# EasyEDA Pro project Access Control Core.eprj, board Card Reader (continued)
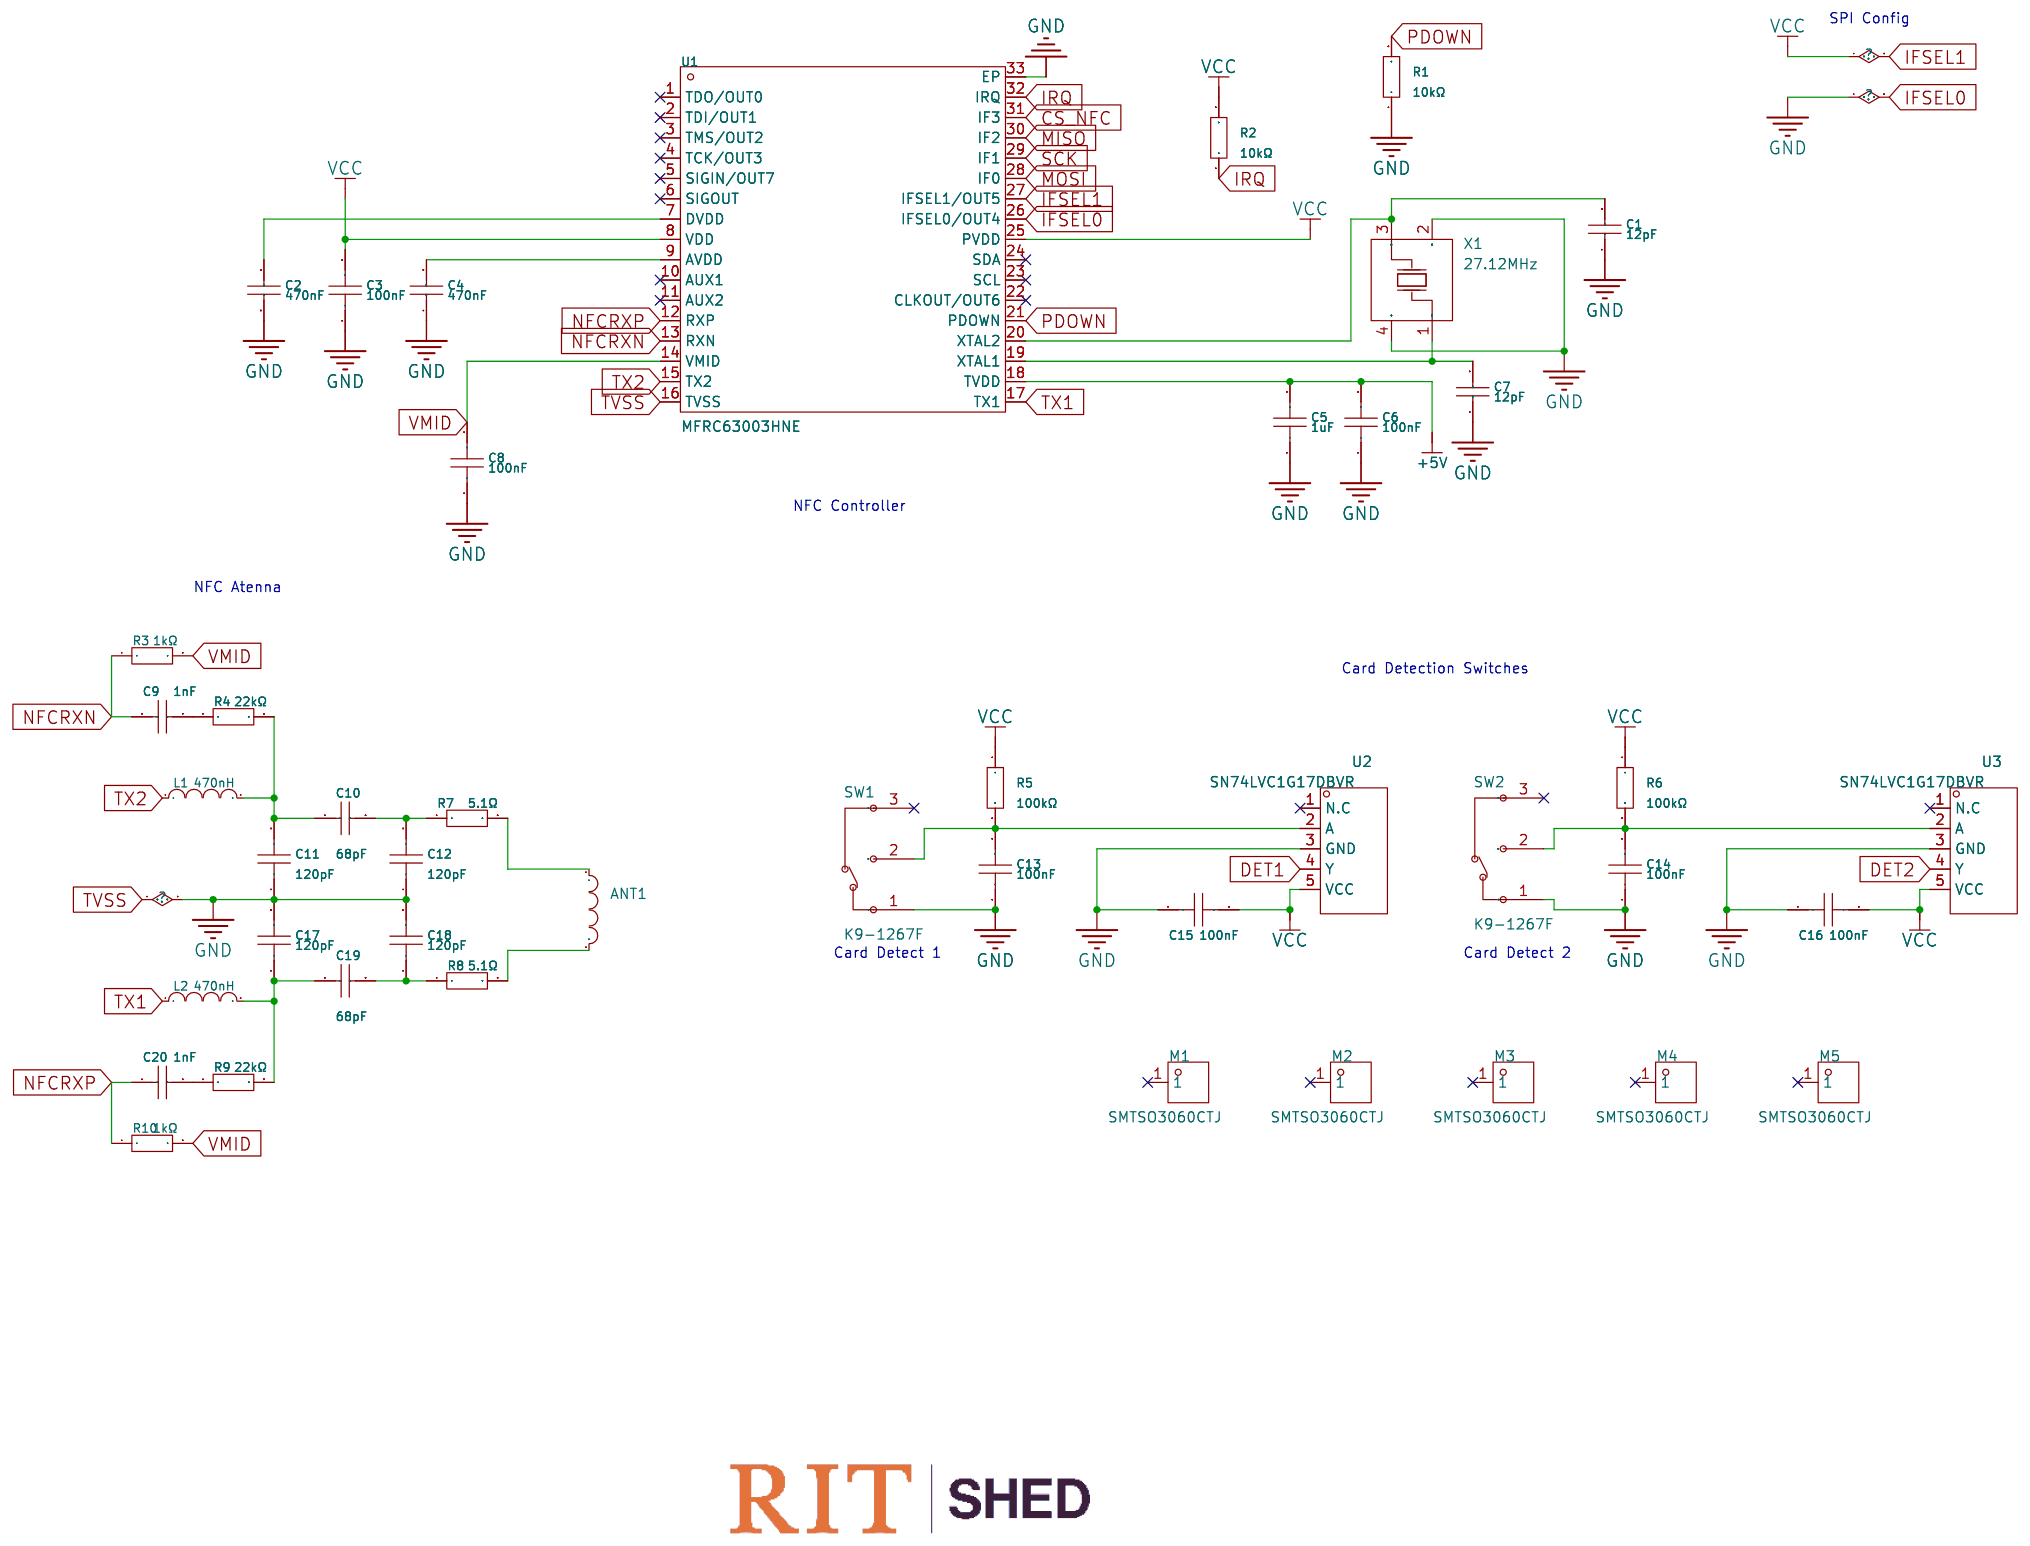
[diagram p0: NFC Reader]
## Footprints (pads in the part's own frame, mm; a bottom-side part is the same pattern mirrored in y, then rotated) (continued)
NFC Antenna Footprint
  round 1.524 hole 0.914: 1(-3.505,-18.542) 1(-3.505,-25.73) 2(3.15,-18.603)
R0603
  rect 0.806x0.864 smd: 1(-0.753,0) 2(0.753,0)
R0805
  rect 1.133x1.377 smd: 1(-1,0) 2(1,0)
RJ45-TH_HC911102A-904-A
  rect 1.6x1.6 hole 1: 1(-4.445,4.355)
  round 1.6 hole 1: 2(-3.175,6.895) 3(-1.905,4.355) 4(-0.635,6.895) 5(0.635,4.355) 6(1.905,6.895) 7(3.175,4.355) 8(4.445,6.895)
  round 1.8 hole 1.1: 9(-6.63,-6.895) 10(-4.09,-6.895) 11(4.09,-6.895) 12(6.63,-6.895)
  round 2.5 hole 1.8: 13(-7.875,1.055) 13(7.875,1.055)
SMD_SMTSO3060CTJ
  custom 2.95x2.95 smd: 1(-2.143,1.579) 1(-1.579,-2.143) 1(1.579,2.143) 1(2.143,-1.579)
SOD-123_L2.7-W1.6-LS3.7-RD-1
  rect 1.2x0.95 smd: 1(-1.7,0) 2(1.7,0)
SOD-123_L2.8-W1.8-LS3.7-RD
  rect 0.95x1.15 smd: 1(-1.692,0) 2(1.692,0)
SOD-123F_L2.8-W1.8-LS3.7-RD
  rect 1x1.2 smd: 1(-1.65,0) 2(1.65,0)
SOT-23-3_L3.0-W1.7-P0.95-LS2.9-BR
  rect 1.038x0.532 smd: 1(1.101,-0.95) 2(1.101,0.95) 3(-1.101,0)
SOT-23-5_L3.0-W1.7-P0.95-LS2.8-BR
  rect 1.1x0.6 smd: 1(1.3,-0.95) 2(1.3,0) 3(1.3,0.95) 4(-1.3,0.95) 5(-1.3,-0.95)
SOT-23-6_L2.9-W1.6-P0.95-LS2.8-BL
  rect 0.532x1.072 smd: 1(-0.95,-1.149) 2(0,-1.149) 3(0.95,-1.149) 4(0.95,1.149) 5(0,1.149) 6(-0.95,1.149)
SOT-23-6_L2.9-W1.6-P0.95-LS2.8-BR
  rect 1.1x0.6 smd: 1(1.35,-0.95) 2(1.35,0) 3(1.35,0.95) 4(-1.35,0.95) 5(-1.35,0) 6(-1.35,-0.95)
SOT-23-6_L2.9-W1.6-P0.95-LS2.9-BL
  rect 0.532x1.072 smd: 1(-0.95,-1.149) 2(0,-1.149) 3(0.95,-1.149) 4(0.95,1.149) 5(0,1.149) 6(-0.95,1.149)
SOT-563_L1.6-W1.2-P0.50-LS1.6-BR
  rect 0.6x0.3 smd: 1(0.75,-0.5) 2(0.75,0) 3(0.75,0.5) 4(-0.75,0.5) 5(-0.75,0) 6(-0.75,-0.5)
SOT-583-8_L2.1-W1.2-P0.50-LS1.6-BR
  rect 0.68x0.28 smd: 1(0.64,-0.75) 2(0.64,-0.25) 3(0.64,0.25) 4(0.64,0.75) 5(-0.64,0.75) 6(-0.64,0.25) 7(-0.64,-0.25) 8(-0.64,-0.75)
SW-SMD_L7.5-W8.0-P4.50_TS-1045-A13B3-D2
  rect 1x3 smd: 1(-2.25,1.15) 2(2.25,1.15)
  rect 1.8x1.3 smd: 3(-4.1,2.3) 3(4.1,2.3)
  oval 2x1.3 hole 1.2x0.6: 3(0,-2.3)
SW-TH_K9-1267F
  round 2.8 hole 1.5: 1(-5.08,0) 2(0,0) 3(5.08,0)
USB-C-SMD_HC-GAP-ACF012-1T-1
  oval 0.9x1.9 hole 0.6x1.6: 0(-1.43,2.375) 0(-1.43,-2.425) 0(1.43,2.375) 0(1.43,-2.425)
  round 0.6 hole 0.4: A1(-0.39,-2.475) A4(-0.39,-1.575) A5(-0.39,-0.675) A6(-0.39,0.225) A7(-0.39,1.125) A9(-0.39,2.025) A12(-0.39,2.925) B1(0.39,2.475) B4(0.39,1.575) B5(0.39,0.675) B6(0.39,-0.225) B7(0.39,-1.125) B9(0.39,-2.025) B12(0.39,-2.925)

## Nets
As in the schematic.

Pads without a net: BZR1 3 4; J1 0 A1 A12 B1 B12; J3 7; LED1 1; LED2 1; M1 1; M2 1; M3 1; M4 1; M5 1; SW1 3; SW2 3; U1 1 2 3 4 5 6 10 11 22 23 24; U2 1; U3 1; U4 1; U5 3; U6 11 12; U13 1 2; U15 1 2; U17 7 12 13 18 24 26 38 39 40 41 42 43 44 45 46 47; U21 4 5; U22 4 5

## Via types
v1: diameter 0.61, hole 0.305, Top Layer to Bottom Layer, 361 vias

## Routing (per net, layer and track width the routed paths; a pad name or vN(x,y) marks a point on that pad's centre or on a via; arc(x,y) is an arc through that point)
+5V: length 342.6
  Top Layer w0.254: C43.2 37.14,59.44 v1(35.43,59.44) ; R44.2 66.93,91.45 66.93,88.4 R46.2 69.71,89.15 73.53,89.15 74.55,88.14 74.55,85.47 71.88,82.8 71.88,79.88 69.72,77.72 64.9,77.72 63.56,76.39 U12.1 61.85,76.39 C44.2 60.26,75.31 54.86,75.31 53.72,74.17 53.72,68.41 53.7,68.39 ; v1(44.3,61.72) 51.44,61.72 52.7,62.99 C32.2 52.96,68.39 53.7,68.39 ; 53.7,68.39 U8.6 ; U11.6 11.07,52.6 11.69,53.22 C40.2 15.24,53.22 16.83,54.8 C36.2 17.4,57.21 U10.6 v1(18.67,58.42) ; v1(44.07,22.4) 44.58,21.89 44.58,21.32 ; U1.18 46.05,21.32 C6.2 44.58,21.32 ; 44.58,21.32 C5.2 ; v1(65.15,50.8) 65.15,54.48 66.04,55.37 66.04,56.01 67.5,57.47 U9.6 67.5,59.43 67.25,59.69
  Top Layer w0.381: U20.1 83.76,13.47 C97.2 83.25,12.95 82.23,12.95 C96.2 80.77,11.36 LED2.2 LED1.2 ; v1(66.42,50.8) v1(65.15,50.8) 62.1,50.8 61.09,51.82 54.99,51.82 52.2,49.02 46.99,49.02 v1(46.38,49.63) 45.59,50.42 ; v1(38.99,60.71) v1(38.99,61.72)
  Top Layer w0.508: v1(12.57,87.38) v1(12.57,88.31) v1(12.57,89.29) 12.57,89.92 12.06,90.43 U22.6 11.51,91.43 C101.2 ; F7.1 38.99,63.42 v1(38.99,61.72) C42.2 ; C99.2 79.88,38.55 U21.6 ; C43.2 C42.2 ; C42.2 34.67,64.45 34.67,65.86 33.4,67.14 33.4,68.53 ; U21.6 v1(82.55,38.55) ; U21.6 v1(81.4,37.72) ; D7.2 33.37,68.5 33.4,68.53 ; F4.1 37.39,80.01 40.89,80.01 41.53,79.38 41.53,76.96 41.15,76.58 v1(39.17,76.58) v1(38.11,76.58) v1(37.03,76.58) 35.44,76.58 33.4,74.55 33.4,68.53
  Bottom Layer w0.254: v1(18.67,58.42) 19.18,57.91 33.91,57.91 v1(35.43,59.44)
  Bottom Layer w0.381: v1(81.4,37.72) 81.4,38.51 81.44,38.55 ; 81.44,38.55 81.03,38.96 81.03,40.17 77.09,44.11 77.09,46.72 73.01,50.8 v1(66.42,50.8) v1(65.15,50.8) ; 81.44,38.55 v1(82.55,38.55) 86.29,38.55 87.72,37.12 87.72,26.38 85.98,24.64 85.98,15.49 83.44,12.95 v1(82.17,12.95) ; v1(38.99,61.72) v1(38.99,60.71)
  Bottom Layer w0.508: v1(12.57,87.38) v1(12.57,88.31) v1(12.57,89.29) 12.57,90.17 14.48,92.08 19.05,92.08 22.48,88.65 22.48,85.09 25.02,82.55 27.05,82.55 31.37,78.23 33.15,78.23 34.8,76.58 v1(37.03,76.58) v1(38.11,76.58) v1(39.17,76.58) ; v1(44.07,22.4) 44.07,28.49 47.05,31.47 47.05,48.97 v1(46.38,49.63) v1(45.62,50.39) 45.62,51.84 47.37,53.59 47.37,56.13 44.3,59.2 v1(44.3,61.72) v1(38.99,61.72)
+5V-BUS: length 37.3
  Top Layer w0.508: C39.2 47.94,89.72 45.59,87.38 40.1,87.38 J2.13 37.56,87.38 34.37,87.38 J2.6 30.86,83.87 D5.5 30.86,78.74 31.11,78.49 33.15,78.49 33.99,79.33 F4.2
+12V: length 144.3
  Top Layer w0.381: C64.2 C65.2 ; C65.2 84.2,23.69 U15.3 ; C65.2 C63.2 ; 60.5,79.5 60.5,79.42 60.64,79.56 C48.2 C47.2 66.17,79.56 C46.2 C49.2 C50.2 ; D6.2 v1(29.85,67.18)
  Top Layer w0.508: v1(87.76,24.16) v1(87.76,23.19) v1(87.76,22.22) 87.76,21.08 87.38,20.7 85.38,20.7 84.25,21.83 C63.2 ; 60.5,79.42 59.56,78.48 v1(59.56,76.94) v1(59.56,75.95) v1(58.66,75.95) 51.69,75.95 49.66,73.91 49.66,70.21 v1(50.29,69.57) v1(50.29,68.2)
  Bottom Layer w0.381: v1(29.85,66.32) v1(29.85,67.18) 32.77,67.18 35.85,70.27 48.87,70.27 49.38,69.76 50.1,69.76 v1(50.29,69.57)
  Bottom Layer w0.508: v1(87.76,22.22) v1(87.76,23.19) v1(87.76,24.16) 87.76,24.64 88.27,25.15 88.27,61.64 86.92,62.99 83.55,62.99 77.45,69.09 73.79,69.09 70.23,72.64 62.86,72.64 v1(59.56,75.95) ; v1(50.29,69.57) v1(50.29,68.2) ; v1(59.56,76.94) v1(59.56,75.95) ; v1(59.56,75.95) v1(58.66,75.95)
+12V-BUS: length 20.5
  Top Layer w0.508: 57.36,79.5 D2.1 54.36,80.77 47.12,80.77 44.32,83.57 J2.5 J2.4 ; C38.2 58.23,78.88 F3.2
AVDD: length 61.7
  Top Layer w0.254: R41.2 v1(81.41,70.1) ; v1(81.41,70.1) 80.64,69.34 78.61,69.34 v1(77.85,70.1) ; v1(81.41,70.1) v1(84.96,70.1) ; v1(77.85,70.1) 77.41,69.66 77.41,65.85 ; v1(77.85,70.1) R43.2 ; C77.2 77.77,57.93 U17.21 ; C77.2 76.07,58.23 76.07,56.58 C76.2 77.6,55.88 78.31,55.17 FB2.2 ; C77.2 76.07,59.63 76.07,61.28 C79.2 ; U17.17 77.99,59.93 77.72,60.2 77.72,61.03 ; C81.2 85.47,66.61 85.47,69.6 v1(84.96,70.1) ; C79.2 C78.2 76.77,65.22 77.41,65.85 ; C79.2 77.72,61.03 ; U17.11 80.94,64.48 80.64,64.77 79.95,64.77 C80.2 77.41,65.85 ; 77.72,61.03 77.82,60.93 U17.15 ; R40.2 v1(84.96,70.1) ; 82.68,65.85 82.44,65.61 U17.8 82.44,62.22 82.68,61.98 84.2,61.98 84.44,62.21 U17.4 84.44,64.37 84.71,64.64 84.71,65.59 84.96,65.85
GND: length 304.8
  Top Layer w0.211: v1(18.21,53.07) 18.26,53.02
  Top Layer w0.254: v1(65.91,60.96) 67.38,60.96 C34.1 ; U9.2 68.45,53.15 C35.1 68.45,53.02 v1(68.45,49.78) ; C100.1 84.52,39.5 U21.2 v1(82.55,39.5) ; U23.GND U23.GND ; U23.GND U23.GND U23.GND ; U23.GND U23.GND U23.GND ; U23.GND U23.GND ; U23.GND U23.GND ; U23.GND U23.GND ; U23.GND U23.GND U23.GND ; U23.GND U23.GND U23.GND ; C90.1 v1(74.55,70.1) ; v1(74.55,70.1) 70.67,70.1 69.72,71.05 69.72,73.47 C45.1 67.75,75.44 U12.5 v1(64.65,75.44) U12.2 61.79,75.44 C44.1 ; v1(74.55,70.1) 75.37,69.28 C78.1 ; v1(85.34,61.47) 85.34,62.32 84.94,62.73 U17.3 ; U11.2 10.12,57.16 C41.1 ; v1(18.21,53.07) U6.7 U6.8 ; 14.61,88.39 12.95,86.74 12.95,82.42 13.81,81.57 18.92,81.57 U23.GND ; U17.16 v1(80.39,60.43) ; U17.23 v1(80.39,56.93) ; 49.4,13.82 50,14.42 X1.2 50.17,15.86 C1.1 v1(53.47,15.86) 53.52,15.8 R1.1 ; U3.3 v1(63.63,55.95) ; C18.2 v1(31.62,23.45) ; v1(31.62,23.45) 37.69,23.45 v1(37.72,23.47) ; v1(31.62,23.45) C12.1 ; U17.9 81.94,62.73 81.43,62.22 v1(81.43,61.09) ; U5.2 18.67,50.29 v1(19.05,50.67) ; 21.46,70.1 20.7,69.34 20.7,67.53 U23.GND ; v1(37.72,23.47) C17.2 ; v1(37.72,23.47) v1(40.77,23.47) ; v1(37.72,23.47) C11.1 ; v1(20.95,83.31) 22.48,83.31 v1(23.5,82.3) 24,81.79 24,75.69 v1(23.75,75.44) 23.71,75.4 D3.2 ; v1(42.55,19.86) 43.75,19.86 C5.1 C6.1 v1(45.34,18.59) ; v1(16.11,83.33) 14.84,83.33 14.48,83.69 14.48,85.85 15.11,86.49 ; D5.2 v1(30.86,76.2) ; v1(42.55,24.43) 42.86,24.43 C8.1 ; C86.1 v1(79.63,70.1) ; D1.2 v1(22.48,76.33) ; v1(46.1,23.67) 46.44,24 46.85,24 47.44,23.41 U1.33 49.91,21.65 U1.26 50.73,20.82 v1(51.44,20.11) ; X2.4 85.66,48.03 C89.2 85.66,46.42 84.45,45.21 83.38,45.21 C75.2 ; U8.2 59.12,69.34 C33.1 ; U17.14 v1(80.39,61.43) ; U17.29 82.44,53.67 C74.1 ; U17.19 v1(80.39,58.93) ; v1(18.67,59.37) U10.2 21.46,59.37 C37.1 ; R23.2 v1(8,50.61) ; v1(47.37,18.84) 47.37,17.85 X1.4 ; C92.1 5.83,82.09 U23.GND ; v1(13.97,57.91) 14.49,58.43 R22.2 15.62,56.83 C36.1 ; 26.17,53.09 25.9,53.09 ; U4.3 60.39,85.16 60.01,84.77 C23.1 ; 25.68,53.09 25.39,53.09
  Top Layer w0.381: U13.4 1.15,35.95 v1(1.14,35.94) ; C97.1 84.71,13.4 U20.2 v1(84.71,16.26) U20.5 84.71,19.37 C98.1 ; LED2.3 82.11,9.47 C96.1
  Top Layer w0.508: U22.2 8.29,89.48 7.59,88.78 C102.1 ; C93.1 C94.1 ; 6.79,63.75 6.79,64.52 ; U23.GND 5.83,65.74 C95.1 ; U23.GND 5.85,66.69 U23.1 U23.2 ; U23.GND U23.GND ; D2.2 51.18,79.5 50.58,78.9 CN2.14 ; v1(47.63,30.97) C4.1 C3.1 C2.2 v1(53.47,29.7)
  Inner2 w0.254: v1(29.08,92.46) 28.58,92.96 12.57,92.96 v1(12.32,92.71)
  Bottom Layer w0.254: v1(23.75,75.44) 23.75,74.17 23.5,73.91 v1(18.8,73.91) ; v1(42.55,24.43) 41.59,23.47 ; 41.59,23.47 v1(40.77,23.47) ; 41.59,23.47 42.55,22.52 v1(42.55,19.86) ; 50.89,20.66 49.07,18.84 v1(47.37,18.84) 47.12,18.59 v1(45.34,18.59) ; v1(51.44,20.11) 51.44,17.89 v1(53.47,15.86)
  Bottom Layer w0.508: 47.88,23.67 48.75,24.54 48.75,29.7 ; 47.88,23.67 v1(46.1,23.67) ; 47.88,23.67 v1(51.44,20.11) ; v1(53.47,29.7) 48.75,29.7 ; 48.75,29.7 48.75,29.85 v1(47.63,30.97) 47.66,31 47.66,49.56 v1(47.31,49.91) v1(46.55,50.67)
  vias: v1(0.89,34.54) v1(1.14,24.38) v1(1.65,32) v1(1.91,16.13) v1(1.97,12.53) v1(2.67,34.54) v1(2.92,17.46) v1(3.11,23.11) v1(3.11,21.84) v1(3.94,27.94) v1(6.22,91.19) v1(6.22,89.41) v1(6.22,13.97) v1(6.35,59.56) v1(6.73,86.11) v1(6.73,84.58) v1(6.73,20.07) v1(6.98,78.99) v1(6.98,74.68) v1(6.98,70.61) v1(8.26,35.56) v1(8.51,69.6) v1(8.76,79.25) v1(9.27,75.69) v1(9.27,73.66) v1(9.27,72) v1(9.4,22.86) v1(9.78,31.75) v1(10.28,77.74) v1(10.28,69.6) v1(11.49,70.36) v1(11.81,64.26) v1(12.87,70.36) v1(13.59,76.96) v1(13.84,64.64) v1(14.1,52.07) v1(14.1,49.28) v1(14.18,54.62) v1(14.61,70.36) v1(15.11,76.96) v1(15.11,64.39) v1(15.45,55.24) v1(16.76,64.77) v1(17.02,90.68) v1(20.19,65.41) v1(21.21,75.69) v1(21.72,63.12) v1(21.97,90.84) v1(27.81,63.12) v1(29.08,76.58) v1(29.85,55.88) v1(30.99,69.22) v1(30.99,68.07) v1(34.88,67.18) v1(35.81,58.67) v1(36.07,67.18) v1(36.96,77.47) v1(37.47,67.22) v1(38.99,59) v1(39.75,53.85) v1(42.8,60.5) v1(42.8,59.44) v1(43.69,80.39) v1(48.58,76.45) v1(50.67,76.45) v1(50.67,73.66) v1(50.67,64.77) v1(51.18,69.6) v1(51.18,68.33) v1(51.69,67.06) v1(51.94,72.64) v1(52.96,53.09) v1(54.23,91.19) v1(54.74,73.44) v1(54.74,66.29) v1(55.25,77.72) v1(57.02,63.5) v1(58.82,61.98) v1(59.05,66.8) v1(60.07,65.53) v1(60.83,70.1) v1(61.85,61.21) v1(62.1,53.72) v1(64.64,82.18) v1(65.91,86.11) v1(69.22,81.28) v1(69.22,79.5) v1(72.01,68.07) v1(73.28,48.51) v1(74.56,68.07) v1(75.74,45.47) v1(76.07,35.81) v1(76.07,34.04) v1(76.07,32.4) v1(76.07,30.73) v1(76.07,23.62) v1(76.58,39.62) v1(76.58,37.72) v1(76.58,29.08) v1(77.6,65.06) v1(78.14,23.65) v1(79.63,23.62) v1(80.64,45.85) v1(80.9,29.97) v1(81.53,68.33) v1(81.66,24.89) v1(82.5,48.73) v1(83.06,12.06) v1(84.2,79.5) v1(84.2,77.47) v1(84.71,33.4) v1(86.61,28.58) v1(86.87,23.75) v1(86.87,22.73) v1(86.87,21.59) v1(87.5,50.04) v1(87.5,47.75)
VCC: length 470.8
  Top Layer w0.211: U6.9 U6.10 23.55,51.57 C27.2
  Top Layer w0.254: 62.36,83.06 63.82,83.06 C24.2 ; 62.36,83.06 62.36,82.84 U4.5 ; 62.36,83.06 v1(62.36,84.07) ; v1(52.96,26.98) 54.46,26.98 R2.2 ; 67.5,56.37 U9.1 67.5,53.6 C35.2 ; U6.2 27.56,52.07 28.07,52.58 40.01,52.58 40.51,53.09 40.51,54.48 39.89,55.11 38.46,55.11 ; U6.2 U6.9 ; U6.2 U6.3 ; v1(52.96,19.17) 52.12,19.17 51.72,19.57 ; R49.2 11.55,83.19 v1(12.32,83.19) ; U8.1 59.05,68.39 C33.2 60.39,68.13 v1(64.01,71.75) ; R11.1 56.51,84.84 v1(54.99,84.84) ; C15.2 26.86,59.95 U2.5 26.86,58.23 26.3,57.67 R52.1 24.84,57.72 C37.2 21.01,58.42 U10.1 v1(20.1,55.63) 20.1,54.77 19.69,54.36 18.16,54.36 17.4,53.59 17.4,52.32 17.79,51.93 ; U3.5 64.93,59.09 C16.2 63.18,58.55 60.71,58.55 R6.1 v1(60.58,60.71) 60.58,62.48 57.53,65.53 57.53,68.07 ; U1.27 51.39,20.87 51.75,20.87 52.2,20.43 52.2,20.05 51.72,19.57 ; R25.2 25.78,75.45 v1(25.78,75.18) ; C98.2 82.74,20.32 v1(81.92,20.32) ; U11.1 11.14,55.08 C41.2 12.45,56.77 12.83,57.15 v1(12.83,57.91) ; 17.79,51.93 18.16,51.56 19.62,51.56 C28.2 C26.2 C27.2 ; 17.79,51.93 17.4,51.54 17.4,50.55 17.15,50.29 U5.5 15.43,50.29 C25.2 ; R55.2 12.32,39.12 11.3,38.1 ; U23.3 8.58,66.99 7.54,68.02 7.54,69.65 8.64,70.74 v1(9.78,70.74) ; v1(24.24,70.1) 24.24,70.9 R24.2 ; 51.72,19.57 51.68,19.53 51.11,19.53 50.85,19.78 50.85,20 50.38,20.47 ; C45.2 67.69,76.39 U12.6 64.7,76.39 v1(64.64,76.33)
  Top Layer w0.381: 50.38,26.35 50.42,26.4 v1(50.42,27.33) C3.2 ; FB1.1 76.38,50.88 77.47,49.78 80.52,49.78 81.47,48.83 C75.1 v1(81.47,43.49) ; U20.6 83.76,19.3 C98.2 ; v1(81.47,43.49) 79.82,43.49 R42.1 79.81,43.88 79.81,45.2 ; v1(81.47,43.49) 81.47,42.86 82.04,42.29 85.08,42.29 R39.1 85.98,43.19 R37.1 ; 1.46,20 0.64,19.18 0.64,7.37 2.16,5.84 7.75,5.84 BZR1.1 10.84,11.13 10.29,11.68 D8.1 ; C51.2 8.52,27.23 R30.1
  Top Layer w0.508: FB1.1 75.31,51.05 v1(74.55,51.82) v1(74.55,52.97) v1(74.55,54.26) 75.71,54.26 FB2.1 ; C93.2 C94.2 C95.2 8.58,65.15 U23.3 ; 67.5,56.37 v1(67.48,56.39) ; 8.52,24.26 6.61,22.35 C56.2 ; 8.52,24.26 R30.1 ; 8.52,24.26 10.67,24.26 11.3,24.89 11.3,38.1 7.24,42.16 v1(7.24,56.64) 7.24,60.24 8.22,61.21 14.36,61.21 17.74,64.59 20.52,64.59 21.21,65.28 21.21,68.33 v1(22.99,70.1) v1(24.24,70.1) v1(25.46,70.1) v1(26.81,70.1) v1(28.07,70.1) 28.07,70.74 29.29,71.96 29.59,71.96
  Top Layer w0.762: 3.94,24.97 4.77,24.14 C56.2 4.77,21.9 5.21,21.46 C57.2 C58.2 C55.2
  Inner1 w0.254: v1(77.22,41.4) 79.3,43.49 v1(81.47,43.49)
  Inner1 w0.508: v1(64.01,71.75) 65.66,73.41 65.66,75.95 65.28,76.33 v1(64.64,76.33)
  Inner2 w0.254: v1(9.78,70.74) 10.92,71.88 10.92,78.61 11.35,79.05 11.37,79.05 11.71,79.39 11.71,82.58 v1(12.32,83.19) ; v1(77.22,41.4) 77.22,21.97 78.87,20.32 v1(81.92,20.32) ; v1(25.78,75.18) 24.24,73.64 v1(24.24,70.1)
  Bottom Layer w0.254: v1(20.1,55.63) 16.64,55.63 15.62,56.64 14.1,56.64 v1(12.83,57.91) 9.78,57.91 8.51,56.64 v1(7.24,56.64) ; v1(54.99,84.84) 61.6,84.84 v1(62.36,84.07) 63.37,83.06 63.37,78.99 64.64,77.72 v1(64.64,76.33) ; v1(60.58,60.71) 60.58,58.05 60.56,58.04 ; v1(52.96,19.17) v1(52.96,26.98)
  Bottom Layer w0.508: v1(74.55,51.82) v1(74.55,52.97) v1(74.55,54.26) 72.42,56.39 67.18,56.39 65.53,58.04 48.27,58.04 ; 48.27,58.04 48.27,32.09 49.94,30.41 53.92,30.41 54.7,29.64 54.7,27.44 54.24,26.98 v1(52.96,26.98) 50.77,26.98 v1(50.42,27.33) ; 48.27,58.04 47.12,59.19 47.12,63.75 45.34,65.53 29.34,65.53 29.08,65.79 29.08,69.09 v1(28.07,70.1) v1(26.81,70.1) v1(25.46,70.1) v1(24.24,70.1) v1(22.99,70.1)
VDD: length 6.7
  Top Layer w0.254: FB1.2 80.2,51.05 C73.2 C74.2 81.22,53.85 81.66,53.85 81.94,54.12 U17.28
ACCESS: length 41.2
  Top Layer w0.254: U12.3 v1(63.29,73.66) 64.63,73.66 R26.1
  Bottom Layer w0.254: v1(63.29,73.66) 63.29,77.55 57.79,83.06 46.36,83.06 44.58,84.84 35.52,84.84 J2.1
ACCESS-SIG: length 74.5
  Top Layer w0.254: v1(64.64,74.49) U12.4 67.12,74.49 68.45,73.15 R27.1 ; 7.73,80.64 7.73,77.62 8.38,76.96 12.06,76.96 v1(12.83,77.72)
  Inner2 w0.254: v1(12.83,77.72) 15.95,80.85 17.98,80.85 18.86,81.73 18.86,83.38 19.43,83.95 22.86,83.95 25.58,81.23 32.94,81.23 34.02,80.14 37.31,80.14 38.63,78.82 52.37,78.82 57.76,73.43 60.61,73.43 61.66,74.49 v1(64.64,74.49)
BUSIO1: length 43.6
  Top Layer w0.254: D5.4 31.81,79.94 ; 31.81,79.94 31.88,80.02 v1(32.64,80.02) ; 31.81,79.94 31.81,83.5 33.15,84.84 36.41,84.84 J2.8 ; U8.4 v1(54.66,72.31)
  Inner1 w0.508: v1(54.66,72.31) 53.82,71.48 34.42,71.48 33.91,71.98 33.91,78.75 v1(32.64,80.02)
BUSIO2: length 67.3
  Top Layer w0.254: J2.9 38.7,84.84 38.23,84.84 37.72,84.33 37.72,82.55 37.21,82.04 35.94,82.04 35.43,81.53 35.43,78.49 34.54,77.6 32.07,77.6 D5.3 31.81,77.03 32.13,76.71 v1(33.15,76.71) ; U9.4 v1(70.74,57.74)
  Inner1 w0.508: v1(33.15,76.71) 33.15,71.88 34.16,70.87 55.75,70.87 56.9,69.72 56.9,67.56 66.72,57.74 v1(70.74,57.74)
BUSIO3: length 47.8
  Top Layer w0.254: U10.4 v1(18.67,60.32) ; v1(29.91,78.49) D5.6 29.91,86.93 32.89,89.92 35.27,89.92 J2.12
  Inner1 w0.508: v1(18.67,60.32) 20.57,60.32 21.97,61.72 29.34,61.72 31.7,64.08 31.7,76.7 v1(29.91,78.49)
BUSIO4: length 67.4
  Top Layer w0.254: v1(29.91,76.2) D5.1 29.91,77.53 29.08,78.36 29.08,86.61 32.9,90.42 41.63,90.42 J2.15 ; U11.4 9.16,52.32 v1(8.15,52.32)
  Inner1 w0.508: v1(8.15,52.32) 8.15,56.03 15.11,62.99 19.94,62.99 21.21,64.26 21.21,67.54 22.76,69.09 28.32,69.09 29.91,70.68 v1(29.91,76.2)
BUTTON: length 82.8
  Top Layer w0.254: v1(8.13,68.71) 9.33,67.5 9.33,67.49 9.43,67.39 U23.4 ; U4.4 60.42,82.8 v1(61.34,82.8)
  Inner2 w0.254: v1(8.13,68.71) 8.13,69.15 7.75,69.53 7.75,77.34 8.13,77.72 8.13,87.5 13.13,92.51 27.68,92.51 v1(28.16,92.03)
  Bottom Layer w0.254: v1(61.34,82.8) 60.73,83.41 46.5,83.41 45.08,84.83 45.08,86.11 43.82,87.38 32.69,87.38 28.16,91.9 v1(28.16,92.03)
BUZZER: length 53.9
  Top Layer w0.254: v1(5.59,16.76) 5.59,15.63 R58.1 ; U23.5 10.29,66.67 v1(10.29,65.53)
  Inner2 w0.254: v1(10.29,65.53) 10.29,64.89 9.76,64.36 9.76,54.1 9.27,53.61 v1(9.27,49.15)
  Bottom Layer w0.254: v1(5.59,16.76) 5.21,17.15 5.21,21.84 8.51,25.15 8.51,33.27 9.27,34.04 v1(9.27,49.15)
CC1: length 4.5
  Top Layer w0.254: R13.2 20.53,87.8 J1.A5
CC2: length 4.2
  Top Layer w0.254: 13.83,89.66 14.22,89.28 v1(14.22,88.9)
  Bottom Layer w0.254: J1.B5 14.22,88.48 v1(14.22,88.9)
CS_NFC: length 95.4
  Top Layer w0.254: 19.83,77.93 U23.28 19.62,77.91 18.92,77.22 16.76,77.22 v1(16.38,76.83) ; v1(54.48,21.64) 53.46,21.64 U1.31 ; v1(49.15,52.83) v1(49.15,59.18)
  Inner2 w0.254: v1(49.15,59.18) 44.32,64.01 44.32,72.9 42.6,74.62 36.26,74.62 33.59,77.29 16.84,77.29 v1(16.38,76.83)
  Bottom Layer w0.254: v1(49.15,52.83) 48.75,52.43 48.75,32.29 50.14,30.9 54.12,30.9 55.63,29.38 55.63,23.9 54.48,22.75 v1(54.48,21.64)
DEBUG-LED: length 86.1
  Top Layer w0.254: LED3.2 49.14,60.45 43.82,60.45 43.56,60.71 43.56,62.23 44.32,62.99 44.32,69.47 45.59,70.74 v1(45.59,80.26) ; 13.68,80.64 13.68,79.84 13.34,79.5 v1(12.83,79.5)
  Inner2 w0.254: v1(12.83,79.5) 13.63,80.31 13.63,90.72 14.35,91.44 18.92,91.44 20.45,89.92 30.61,89.92 31.52,90.83 43.16,90.83 47.14,86.85 47.14,83.08 45.59,81.53 45.59,80.52
DET1: length 32.8
  Top Layer w0.254: U2.4 29.62,58.45 v1(30.1,58.93) ; U23.27 19.66,77.06 19.16,76.57 17.13,76.57 v1(16.51,75.95)
  Inner2 w0.254: v1(30.1,58.93) 27.43,61.59 20.83,61.59 19.43,62.99 19.43,66.04 18.92,66.55 17.91,66.55 17.02,67.44 17.02,70.49 16.54,70.97 16.54,76.1 16.51,76.07 v1(16.51,75.95)
DET2: length 64.2
  Top Layer w0.254: U23.26 17.79,76.21 v1(17.27,75.69) ; U3.4 v1(64.93,56.9)
  Inner2 w0.254: v1(64.93,56.9) 46.86,56.9 45.08,58.67 41.02,58.67 39.75,59.94 36.7,59.94 34.67,61.98 24.51,61.98 19.56,66.93 18.03,66.93 17.37,67.58 17.37,70.64 16.89,71.12 16.89,75.31 v1(17.27,75.69)
DM: length 32.8
  Top Layer w0.275: J1.B7 16.04,88.04 15.1,88.04 13.49,86.43 13.49,82.73 14.15,82.07 20.29,82.07 v1(20.41,81.95) 20.54,82.07 21.31,82.07 21.53,81.85 D1.6 D1.1 21.53,76.44 22.24,75.73 22.24,74.36 21.54,73.66 U23.23 ; J1.A7 17.24,86.21 18.4,86.21 19.84,84.77 19.84,83.43 v1(19.73,83.31)
  Bottom Layer w0.275: v1(19.73,83.31) 19.73,82.63 v1(20.41,81.95)
DP: length 33.3
  Top Layer w0.275: v1(21.59,74.55) 21.18,74.14 20.38,74.14 20.01,74.51 U23.24 ; 20.32,82.55 20.32,84.96 18.6,86.69 17.24,86.69 J1.A6 ; 20.32,82.55 14.35,82.55 13.97,82.93 13.97,86.23 15.3,87.56 16.04,87.56 J1.B6 ; 20.32,82.55 21.84,82.55 23.43,80.96 D1.4 D1.3 23.43,76.44 22.72,75.73 22.72,74.82 v1(22.99,74.55)
  Bottom Layer w0.275: v1(22.99,74.55) v1(21.59,74.55)
ESP-EN: length 4.3
  Top Layer w0.254: R49.1 C92.2 6.88,81.74 6.88,80.64
ETH_CS: length 109.9
  Top Layer w0.254: v1(15.75,78.49) 17.08,79.81 17.08,80.64 ; U17.32 83.94,53.86 84.2,53.59 v1(85.73,53.59) ; 79.81,47.8 v1(79.81,46.48) 79.63,46.48 78.87,45.72 78.87,44.44 R42.2
  Inner2 w0.254: v1(15.75,78.49) 17.04,79.78 21.12,79.78 21.5,80.16 30.71,80.16 31.8,79.08 36.87,79.08 38.19,77.75 51.93,77.75 57.32,72.36 69.25,72.36 73.08,68.54 73.08,65.68 71.76,64.36 v1(71.76,63.5)
  Bottom Layer w0.254: v1(79.81,46.48) 79.81,47.18 85.73,53.09 v1(85.73,53.59) 85.22,54.1 85.22,57.91 83.74,59.39 83.74,61.11 81.77,63.08 72.17,63.08 v1(71.76,63.5)
ETH_INT: length 94.7
  Top Layer w0.254: v1(86.11,56.64) 85.94,56.47 U17.36 ; U23.18 19.79,69.47 v1(18.67,69.47) ; v1(84.2,44.45) 84.2,43.44 R39.2
  Bottom Layer w0.254: v1(84.2,44.45) 84.2,51.06 86.49,53.35 86.49,56.26 v1(86.11,56.64) 86.11,57.53 84.1,59.53 84.1,61.25 81.91,63.44 72.83,63.44 72.19,64.08 71.32,64.08 70.32,63.08 60.47,63.08 52.31,71.25 50.04,71.25 49.54,71.75 28.94,71.75 28.94,71.76 22.1,71.76 19.81,69.47 v1(18.67,69.47)
ETH_RST: length 104.7
  Top Layer w0.254: v1(87.12,55.75) 87.12,56.12 U17.37 ; 16.23,80.64 16.23,79.85 15.11,78.74 v1(15.11,77.98) ; R37.2 86.87,45.46 v1(86.87,46.99)
  Inner2 w0.254: v1(73.02,64.64) 73.02,65.13 73.43,65.53 73.43,68.69 69.4,72.72 57.46,72.72 52.07,78.11 38.34,78.11 37.02,79.43 31.95,79.43 30.86,80.52 23.75,80.52 22.81,81.46 22.24,81.46 20.92,80.14 16.38,80.14 15.11,78.87 v1(15.11,77.98)
  Bottom Layer w0.254: v1(86.87,46.99) 86.87,55.5 v1(87.12,55.75) 87.12,57.01 84.46,59.68 84.46,61.4 82.06,63.8 73.87,63.8 v1(73.02,64.64)
GPIO1: length 61.7
  Top Layer w0.254: 14.53,80.64 14.53,79.3 13.84,78.61 v1(12.45,78.61) ; R16.2 59.82,73.02 v1(59.82,74.68)
  Inner2 w0.254: v1(59.82,74.68) 58.93,73.79 57.91,73.79 52.52,79.18 38.78,79.18 37.46,80.5 34.17,80.5 33.09,81.59 25.72,81.59 23.01,84.3 19.28,84.3 18.5,83.52 18.5,81.88 17.83,81.2 15.8,81.2 13.21,78.61 v1(12.45,78.61)
GPIO2: length 86.6
  Top Layer w0.254: R17.2 72.76,54.1 v1(72.77,54.1) ; 15.38,80.64 15.37,80.63 15.37,79.63 14.22,78.49 v1(14.22,77.98)
  Inner2 w0.254: v1(14.22,77.98) 14.22,78.61 16.1,80.49 20.77,80.49 22.09,81.81 22.96,81.81 23.9,80.87 32.79,80.87 33.88,79.79 37.17,79.79 38.49,78.47 52.22,78.47 57.61,73.08 69.55,73.08 73.79,68.83 73.79,62.74 72.77,61.72 v1(72.77,54.1)
GPIO3: length 4.8
  Top Layer w0.254: v1(17.91,65.66) 17.91,66.67 U23.14 ; v1(18.03,63.88) 18.04,63.87 R18.2
  Inner2 w0.254: v1(18.03,63.88) 17.91,64.01 v1(17.91,65.66)
GPIO4: length 13.6
  Top Layer w0.254: v1(9.92,67.73) 10.38,67.73 11.13,66.98 U23.6 ; v1(8,57.97) 8.85,57.97 9.1,58.22
  Inner2 w0.254: v1(8,57.97) 9.41,59.38 9.41,67.22 v1(9.92,67.73)
INTERRUPT: length 16.4
  Top Layer w0.254: v1(28.32,82.8) 28.32,79.71 D4.1 28.24,78.4 27.55,77.72 R60.1 R25.1
  Inner2 w0.254: 35.39,86.11 34.37,85.09 33.91,85.09 33.15,84.33 29.85,84.33 v1(28.32,82.8)
INTERRUPT-READ: length 16.9
  Top Layer w0.254: U23.25 19.8,75.31 18.03,75.31 17.65,74.93 v1(17.65,73.66) ; R60.2 v1(27.66,76.21)
  Bottom Layer w0.254: v1(17.65,73.66) 18.29,73.02 20.83,73.02 21.34,73.54 24.39,73.54 25.27,74.42 26.8,74.42 27.66,75.29 v1(27.66,76.21)
IODIR1: length 57.1
  Top Layer w0.254: 17.93,80.64 17.93,79.71 16.64,78.42 v1(16.64,78.36) ; U8.5 v1(55.75,69.34) 55.75,71.38 R20.1 58.55,74.18 v1(58.55,74.68)
  Inner2 w0.254: v1(16.64,78.36) 16.64,78.74 17.32,79.42 21.27,79.42 21.65,79.81 30.57,79.81 31.65,78.72 36.72,78.72 38.05,77.4 51.78,77.4 55.75,73.42 v1(55.75,69.34)
IODIR2: length 83
  Top Layer w0.254: 12.83,80.64 12.83,80.39 11.56,79.12 v1(11.56,77.98) ; U9.5 68.45,58.68 R21.1 70.49,59.44 70.99,59.94 v1(70.99,64.77)
  Bottom Layer w0.254: v1(11.56,77.98) 11.56,76.96 13.59,74.93 18.16,74.93 20.19,76.96 28.07,76.96 28.32,76.71 28.32,74.93 29.71,73.53 40.89,73.53 41.78,74.42 48.89,74.42 49.4,73.91 49.4,72.39 50.19,71.6 52.46,71.6 60.62,63.44 69.66,63.44 v1(70.99,64.77)
IODIR3: length 11.2
  Top Layer w0.254: v1(14.35,59.94) R22.1 16.18,59.37 U10.5 ; v1(13.72,65.53) 13.72,66.65 U23.9
  Inner2 w0.254: v1(14.35,59.94) 13.59,59.94 13.18,60.35 13.18,65 v1(13.72,65.53)
IODIR4: length 32.7
  Top Layer w0.254: v1(10.12,53.59) U11.5 10.12,51.37 R23.1 ; v1(8.76,77.85) 10.28,79.36 10.28,80.64
  Inner2 w0.254: v1(8.76,77.85) 8.1,77.19 8.1,71.53 9.4,70.23 9.4,69.34 10.92,67.82 10.92,65.02 10.12,64.22 v1(10.12,53.59)
IRQ: length 89.2
  Top Layer w0.254: R2.1 54.48,24.58 52.85,22.95 53.4,22.4 v1(55.5,22.4) ; v1(14.48,67.82) 14.48,66.73 U23.10
  Inner2 w0.254: v1(49.36,51.1) 48.74,51.71 42.65,51.71 41.15,53.22 41.15,54.99 38.4,57.73 17.58,57.73 14.48,60.83 v1(14.48,67.82)
  Bottom Layer w0.254: v1(49.36,51.1) 49.36,51 49.11,50.75 49.11,32.44 50.29,31.25 54.27,31.25 57,28.52 57,23.9 v1(55.5,22.4)
LED: length 109.4
  Top Layer w0.254: U23.11 15.37,66.67 v1(15.37,65.53) ; U20.4 v1(86.74,17.61)
  Inner2 w0.254: v1(15.37,65.53) 15.77,65.13 15.77,64.31 21.99,58.09 38.55,58.09 41.5,55.14 41.5,53.37 42.8,52.07 72.26,52.07 76.58,47.75 76.58,43.05 78.87,40.77 78.87,22.1 79.65,21.31 82.19,21.31 83.69,19.81 85.73,19.81 86.74,18.8 v1(86.74,17.61)
MISO: length 164.8
  Top Layer w0.254: U16.4 77.85,45.26 v1(77.85,46.23) 76.83,47.24 v1(76.83,49.4) ; v1(58.04,20.62) 53.77,20.62 U1.30 ; U23.15 18.8,66.67 v1(18.8,65.41)
  Bottom Layer w0.254: v1(58.04,20.62) 58.66,21.24 58.66,28.96 54.94,32.68 50.88,32.68 50.53,33.02 50.53,49.28 52.82,51.56 72.84,51.56 77.85,46.55 v1(77.85,46.23) ; v1(18.8,65.41) 18.8,66.17 21.05,68.42 21.05,69.18 22.56,70.69 28.5,70.69 28.5,70.69 49.05,70.69 49.55,70.18 51.87,70.18 60.03,62.02 81.32,62.02 82.17,61.17 82.17,51.55 79.08,48.46 77.77,48.46 v1(76.83,49.4)
MOSI: length 167.3
  Top Layer w0.254: U23.16 19.83,67.69 v1(18.8,67.69) ; U17.35 85.47,54.97 85.47,57.4 84.45,58.42 v1(82.8,58.42) ; v1(56.52,18.59) 54.54,18.59 51.9,21.23 51.74,21.23 51.44,21.53
  Bottom Layer w0.254: v1(18.8,67.69) 19.81,67.69 20.69,68.57 20.69,69.34 22.4,71.04 28.65,71.04 28.65,71.04 49.19,71.04 49.7,70.54 52.01,70.54 60.18,62.37 81.47,62.37 82.8,61.04 v1(82.8,58.42) 82.8,51.68 79.23,48.11 77.3,48.11 73.14,52.27 52.52,52.27 49.82,49.57 49.82,32.73 50.58,31.96 54.64,31.96 57.94,28.66 57.94,22.56 56.01,20.62 56.01,19.1 v1(56.52,18.59)
NFCRXN: length 10.6
  Top Layer w0.254: 48.03,24.94 43.21,29.76 C9.1 41.47,31.74 R3.1
NFCRXP: length 17
  Top Layer w0.254: v1(42.54,18.08) 42.48,18.08 C20.1 41.47,15.09 R10.1 ; v1(46.86,27.22) 46.86,26.82 48.39,25.29
  Bottom Layer w0.254: v1(42.54,18.08) 45.08,20.63 45.08,25.45 v1(46.86,27.22)
ONEWIRE: length 61.4
  Top Layer w0.254: v1(17.65,72.14) 18.29,72.77 19.81,72.77 U23.22 ; v1(48.64,73.66) 48.64,71.69 CN2.11 ; v1(27.94,72.39) 27.94,72.43 D3.1 26.84,73.53 v1(25.27,73.53) 25.26,73.52 R24.1
  Inner1 w0.508: v1(27.39,83.44) 27.39,82.21 28.37,81.23 28.37,72.82 v1(27.94,72.39)
  Bottom Layer w0.254: v1(25.27,73.53) 24.92,73.18 21.49,73.18 20.95,72.64 18.16,72.64 v1(17.65,72.14) ; v1(27.94,72.39) 28.81,72.39 29.09,72.11 47.09,72.11 v1(48.64,73.66) ; v1(27.39,83.44) 32.39,83.44 33.66,82.17 35.14,82.17 J2.2
PDOWN: length 101.3
  Top Layer w0.254: U23.8 v1(12.83,67.82) ; 48.39,21.53 47.88,21.03 47.88,20.62 49.91,18.59 53.46,18.59 v1(53.77,18.27) R1.2
  Inner2 w0.254: v1(50.29,51.05) 49.66,50.42 49.01,50.42 48.07,51.36 42.5,51.36 40.79,53.07 40.79,54.84 38.25,57.38 17.43,57.38 15.63,59.18 13.84,59.18 12.83,60.2 v1(12.83,67.82)
  Bottom Layer w0.254: v1(50.29,51.05) 49.46,50.22 49.46,32.58 50.44,31.61 54.42,31.61 57.59,28.44 57.59,22.81 53.77,18.99 v1(53.77,18.27)
RX: length 70.8
  Top Layer w0.254: v1(26.55,91.69) 27.05,91.19 v1(30.61,91.19) ; 11.13,80.64 v1(11.13,79.63)
  Inner2 w0.254: v1(47.5,81.79) 47.5,87 43.31,91.19 v1(30.61,91.19) ; 45.59,67.31 45.59,74.55 v1(47.5,76.45) ; v1(26.55,91.69) 26.09,92.15 14.06,92.15 11.81,89.91 11.81,83.63 11.13,82.94 v1(11.13,79.63)
  Bottom Layer w0.254: v1(47.5,76.45) v1(47.5,81.79)
RXN: length 21.2
  Top Layer w0.211: U17.5 v1(83.94,64.77) ; R48.2 72.72,72.65 C85.2 v1(72.77,71.5)
  Bottom Layer w0.211: v1(83.94,64.77) 82.98,65.73 82.98,70.69 82.17,71.5 v1(72.77,71.5)
RXP: length 17
  Top Layer w0.211: U17.6 83.44,64.39 83.35,64.48 83.35,65.83 v1(83.57,66.04) ; v1(83.39,71.37) 83.39,72.5 82.48,73.41 77.08,73.41 R47.2
  Bottom Layer w0.211: v1(83.57,66.04) 83.39,66.21 v1(83.39,71.37)
SCK: length 163.4
  Top Layer w0.254: U23.17 19.83,68.58 v1(18.54,68.58) ; v1(57.02,19.6) 54.07,19.6 51.79,21.89 ; v1(83.95,56.9) 84.44,56.41 U17.33
  Bottom Layer w0.254: v1(18.54,68.58) 19.43,68.58 22.25,71.4 28.79,71.4 28.8,71.4 49.34,71.4 49.85,70.89 52.16,70.89 60.33,62.73 81.62,62.73 83.39,60.96 83.39,57.45 v1(83.95,56.9) 83.95,52.32 79.38,47.75 77.16,47.75 72.99,51.92 52.67,51.92 50.17,49.42 50.17,32.88 50.73,32.32 54.79,32.32 58.3,28.81 58.3,22.41 57.02,21.13 v1(57.02,19.6)
SCL: length 43
  Top Layer w0.254: v1(20.32,50.17) 19.43,50.17 19.06,49.79 U5.1 ; v1(11.94,65.53) 11.94,66.65 U23.7 ; U6.1 v1(28.32,51.57) ; v1(24.89,60.96) R52.2
  Inner1 w0.254: v1(24.89,60.96) 25.52,60.96 28.32,58.16 v1(28.32,51.57) 27.68,51.57 26.8,50.7 20.85,50.7 v1(20.32,50.17)
  Inner2 w0.254: v1(17.09,65.53) 17.45,65.17 17.45,63.64 20.13,60.96 v1(24.89,60.96)
  Bottom Layer w0.254: v1(11.94,65.53) 12.95,66.55 16.07,66.55 v1(17.09,65.53)
SCREEN1: length 28.5
  Top Layer w0.254: U23.21 19.8,72.01 v1(18.54,72.01) ; CN2.5 42.58,73.63 v1(42.55,73.66)
  Bottom Layer w0.254: v1(42.55,73.66) 42.06,73.18 29.57,73.18 29.01,73.74 27.38,73.74 26.47,72.82 21.65,72.82 20.84,72.01 v1(18.54,72.01)
SCREEN2: length 30.4
  Top Layer w0.254: CN2.7 v1(44.58,73.66) ; U23.20 19.84,71.12 v1(18.8,71.12)
  Bottom Layer w0.254: v1(18.8,71.12) 20.45,71.12 21.8,72.47 26.63,72.47 27.54,73.38 28.83,73.38 29.39,72.82 43.74,72.82 v1(44.58,73.66)
SCREEN3: length 34.3
  Top Layer w0.254: CN2.9 v1(46.58,73.66) ; U23.19 19.82,70.23 v1(18.29,70.23)
  Bottom Layer w0.254: v1(46.58,73.66) 46.58,72.72 46.32,72.47 29.24,72.47 28.68,73.03 27.69,73.03 26.77,72.11 21.95,72.11 20.07,70.23 v1(18.29,70.23)
SCREEN4: length 32.3
  Top Layer w0.254: v1(17.4,78.36) 18.78,79.74 18.78,80.64 ; CN2.6 v1(42.58,76.45)
  Inner2 w0.254: v1(17.4,78.36) 17.4,78.74 17.73,79.07 21.42,79.07 21.77,79.43 30.44,79.43 31.5,78.36 34.03,78.36 36.7,75.69 41.82,75.69 v1(42.58,76.45)
SCREEN5: length 32.5
  Top Layer w0.254: v1(18.29,78.36) 19.54,79.61 U23.30 ; CN2.8 v1(44.58,76.45)
  Inner2 w0.254: v1(44.58,76.45) 43.46,75.34 36.55,75.34 33.88,78.01 31.36,78.01 30.3,79.07 21.92,79.07 21.21,78.36 v1(18.29,78.36)
SCREEN6: length 38.7
  Top Layer w0.254: v1(46.61,76.45) 46.61,78.2 CN2.10 ; v1(15.88,77.65) 18.47,77.65 19.58,78.76 U23.29
  Inner2 w0.254: v1(46.61,76.45) 45.14,74.98 36.4,74.98 33.74,77.65 v1(15.88,77.65)
SDA: length 41.8
  Top Layer w0.254: U5.6 17.17,49.28 19.43,49.28 v1(19.69,49.53) ; U23.13 17.08,67.76 v1(16.13,68.71) ; v1(23.37,60.25) 23.37,59.18 R53.2 ; U6.4 v1(27.71,53.07)
  Inner1 w0.254: v1(23.37,60.25) 25.73,60.25 27.71,58.27 v1(27.71,53.07) 27.71,52.11 26.66,51.05 20.38,51.05 19.69,50.36 v1(19.69,49.53)
  Inner2 w0.254: v1(16.13,68.71) 16.13,64.46 20.34,60.25 v1(23.37,60.25)
TX: length 69.6
  Top Layer w0.254: v1(12.45,81.92) 11.98,81.45 11.98,80.64
  Inner2 w0.254: v1(49.66,81.79) 47.85,83.59 47.85,87.14 43.45,91.54 31.88,91.54 31.47,91.95 29.85,91.95 29,91.11 25.86,91.11 25.17,91.8 14.2,91.8 13.28,90.87 13.28,82.74 v1(12.45,81.92) ; 48.13,67.31 48.13,70.36 49.66,71.88 v1(49.66,76.45)
  Bottom Layer w0.254: v1(49.66,76.45) v1(49.66,81.79)
TX1: length 7
  Top Layer w0.254: 46.97,22.95 46.88,22.86 45.89,22.86 45.55,23.2 42.84,23.2 41.47,21.83 L2.1
TX2: length 8.1
  Top Layer w0.254: L1.1 41.47,24.49 42.4,23.56 44.98,23.56 46.1,24.68 46.87,24.68 U1.15
TXN: length 21.2
  Top Layer w0.211: v1(86.49,64.77) 85.94,64.22 U17.1 ; J3.2 81.41,77.65 v1(81.41,75.95) R41.1
  Bottom Layer w0.211: v1(86.49,64.77) 86.31,64.94 86.31,75.1 85.47,75.95 v1(81.41,75.95)
TXP: length 21.1
  Top Layer w0.211: J3.1 82.12,80.32 82.12,76.37 83.19,75.31 v1(84.96,75.31) R40.1 ; U17.2 85.44,64.73 v1(85.73,65.02)
  Bottom Layer w0.211: v1(84.96,75.31) 85.9,74.38 85.9,65.2 v1(85.73,65.02)
VARIANT: length 35.3
  Top Layer w0.254: U23.12 16.23,67.47 v1(15.11,68.58) ; R56.2 R55.1 v1(11.05,43.67)
  Inner2 w0.254: v1(15.11,68.58) 12.57,68.58 11.35,67.36 11.35,64.95 10.48,64.07 10.48,54.36 11.05,53.78 v1(11.05,43.67)
VMID: length 28.4
  Top Layer w0.254: v1(42.8,26.21) 44.01,26.21 C8.2 47.07,25.19 U1.14 ; R10.2 v1(38.73,15.03) ; v1(38.73,31.8) R3.2
  Bottom Layer w0.254: 41.78,26.21 38.73,29.26 v1(38.73,31.8) ; 41.78,26.21 38.73,23.16 v1(38.73,15.03) ; 41.78,26.21 v1(42.8,26.21)
VUSB: length 52.1
  Top Layer w0.254: R59.2 v1(20.45,88.65)
  Top Layer w0.508: v1(22.48,78.49) D1.5 v1(22.48,80.87) ; v1(10.03,85.6) 11.18,85.6 11.48,85.3 F5.1 11.48,84.88 11.11,84.52 v1(10.03,84.52)
  Bottom Layer w0.254: 19.05,86.77 20.1,86.77 20.45,87.12 v1(20.45,88.65) ; 19.16,86.1 19.05,86.21
  Bottom Layer w0.508: 18.92,82.09 18.92,86.08 19.05,86.21 19.05,86.77 17.32,88.5 17.22,88.5 J1.A4 16.8,88.7 16.54,88.95 16.44,88.95 J1.B9 ; 18.92,82.09 14.66,82.09 13.9,82.84 13.9,85.41 14.61,86.11 15.59,86.11 15.95,85.74 16.05,85.74 J1.B4 16.48,85.55 16.73,85.29 16.83,85.29 J1.A9 ; 18.92,82.09 20.14,80.87 v1(22.48,80.87) ; v1(22.48,78.49) 22.48,79.38 21.84,80.01 19.81,80.01 18.67,81.15 11.56,81.15 10.03,82.68 v1(10.03,84.52) v1(10.03,85.6)
